# Altium schematic sheet cm4-power.SchDoc: CM4 Power Supply
size A4; Organization: Institut d'Automatisation Industrielle; SVN: OUI; ProjectName: <projet>
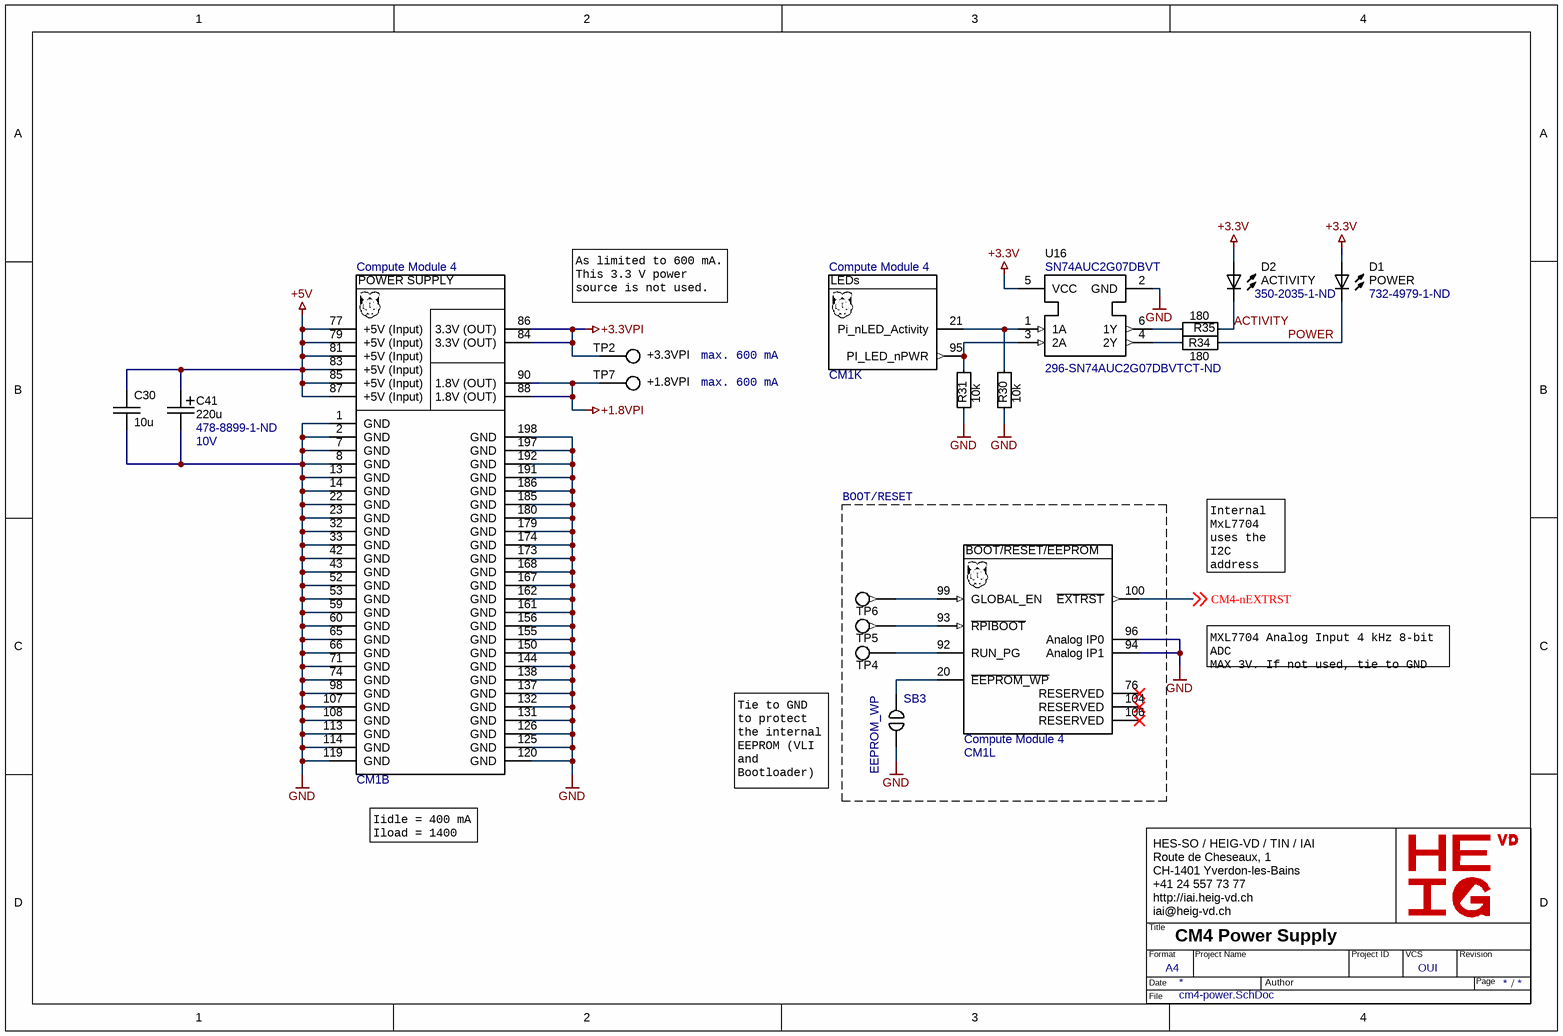
[diagram p0: cm4-power.SchDoc]

## Parts
C30  10u  [SM/C0805]
C41  220u  Supplier Part Number 1: 478-8899-1-ND  Voltage: 10V  [CAPPM6032X280N]
CM1  Compute Module 4  [CM4-RASPBERRY-PI4]  (parts B,K,L of 16)
D1  POWER  Supplier Part Number 1: 732-4979-1-ND  [SM/LED0603]
D2  ACTIVITY  Supplier Part Number 1: 350-2035-1-ND  [SM/LED0603]
R30  10k  [SM/R0603]
R31  10k  [SM/R0603]
R34  180  [SM/R0603]  (net tie)
R35  180  [SM/R0603]  (net tie)
SB3  EEPROM_WP  [JUMPER/SB]  (net tie, no BOM)
TP2  +3.3VPI  [TP/SMALL]  (no BOM)
TP4  RUN_PG  [TP/SMALL]  (value not drawn)  (no BOM)
TP5  nRPIBOOT  [TP/SMALL]  (value not drawn)  (no BOM)
TP6  GLOBAL_EN  [TP/SMALL]  (value not drawn)  (no BOM)
TP7  +1.8VPI  [TP/SMALL]  (no BOM)
U16  SN74AUC2G07DBVT  Supplier Part Number 1: 296-SN74AUC2G07DBVTCT-ND  [SOT23-6]

## Blocks framed on the sheet
BOOT/RESET: CM1 SB3 TP4-TP6

## Nets
+1.8VPI: CM1.88(1.8V_(OUT)) CM1.90(1.8V_(OUT)) TP7.1
+3.3V: D1.1 D2.1 U16.5(VCC)
+3.3VPI: CM1.84(3.3V_(OUT)) CM1.86(3.3V_(OUT)) TP2.1
+5V: C30.1 C41.1(+) CM1.77(+5V_(Input)) CM1.79(+5V_(Input)) CM1.81(+5V_(Input)) CM1.83(+5V_(Input)) CM1.85(+5V_(Input)) CM1.87(+5V_(Input))
GND: C30.2 C41.2(-) CM1.1(GND) CM1.2(GND) CM1.7(GND) CM1.8(GND) CM1.13(GND) CM1.14(GND) CM1.22(GND) CM1.23(GND) CM1.32(GND) CM1.33(GND) CM1.42(GND) CM1.43(GND) CM1.52(GND) CM1.53(GND) CM1.59(GND) CM1.60(GND) CM1.65(GND) CM1.66(GND) CM1.71(GND) CM1.74(GND) CM1.94(Analog_IP1) CM1.96(Analog_IP0) CM1.98(GND) CM1.107(GND) CM1.108(GND) CM1.113(GND) CM1.114(GND) CM1.119(GND) CM1.120(GND) CM1.125(GND) CM1.126(GND) CM1.131(GND) CM1.132(GND) CM1.137(GND) CM1.138(GND) CM1.144(GND) CM1.150(GND) CM1.155(GND) CM1.156(GND) CM1.161(GND) CM1.162(GND) CM1.167(GND) CM1.168(GND) CM1.173(GND) CM1.174(GND) CM1.179(GND) CM1.180(GND) CM1.185(GND) CM1.186(GND) CM1.191(GND) CM1.192(GND) CM1.197(GND) CM1.198(GND) R30.2 R31.2 SB3.2 U16.2(GND)
ACTIVITY: D2.2 R35.2
CM4-nEXTRST: CM1.100(~{EXTRST}) ; off-sheet CM4-nEXTRST
POWER: D1.2 R34.2
NetCM1_20: CM1.20(~{EEPROM_WP}) SB3.1
NetCM1_21: CM1.21(Pi_nLED_Activity) R30.1 U16.1(1A)
NetCM1_92: CM1.92(RUN_PG) TP4.1
NetCM1_93: CM1.93(~{RPIBOOT}) TP5.1
NetCM1_95: CM1.95(PI_LED_nPWR) R31.1 U16.3(2A)
NetCM1_99: CM1.99(GLOBAL_EN) TP6.1
NetR34_1: R34.1 U16.4(2Y)
NetR35_1: R35.1 U16.6(1Y)

Not connected (* = marked no-connect by the designer): CM1 76(RESERVED)* 104(RESERVED)* 106(RESERVED)*

## Notes on the sheet
- As limited to 600 mA. This 3.3 V power source is not used.
- max. 600 mA
- Internal MxL7704 uses the I2C address 0x2D
- MXL7704 Analog Input 4 kHz 8-bit ADC
  MAX 3V. If not used, tie to GND
- Tie to GND to protect the internal EEPROM (VLI and Bootloader)
- (near CM1) Iidle = 400 mA
  Iload = 1400 mA
- HES-SO / HEIG-VD / TIN / IAI
  Route de Cheseaux, 1
  CH-1401 Yverdon-les-Bains
  +41 24 557 73 77
  http://iai.heig-vd.ch
  iai@heig-vd.ch
- Title
- Format
- Date
- A4
- Project Name
- Author
- Project ID
- VCS
- Revision
- Page
- /
- File
- (in symbol CM4, part B) POWER SUPPLY
- (in symbol CM4, part K) LEDs
- (in symbol CM4, part L) BOOT/RESET/EEPROM

## Library data of the parts
C30 = C: CAP CER 10UF 10V X5R 0805; Supplier 1: Digi-Key; Supplier Part Number 1: 1276-2402-1-ND
C41 = C+2312: CAP TANT 220UF 20% 10V 2312; Supplier 1: Digi-Key
CM1 = CM4: Raspberry Pi Compute Module 4 by Amornthep Phunsin
D1 D2 = LED: Supplier 1: Digi-Key
R30 R31 R34 R35 = R: Chip Resistor SMD
SB3 = SOLDER-BRIDGE
TP2 TP4-TP7 = TP: Test Point
U16 = SN74LVC2G07: Buffer, Non-Inverting 2 Element 1 Bit per Element Open Drain Output SOT-23-6; Supplier 1: Digi-Key